# Altium schematic sheet SysUprTestUUUp.SchDoc (part 1 of 2)
size 839 x 594 mm; DecimalNumber: Э- 917.01Э3; MainDevice: Плата управления; Name: Плата управления; PageSetup: Record=PageOptions|CenterHorizontal=True|CenterVertical=True|PrintScale=0.94|XCorrection=1.00|YCorrection=1.00|PrintKind=1|BorderSize=5000000|LeftOffset=0|BottomOffset=0|Orientation=1|PaperLength=1000|PaperWidth=1000|Scale=100|PaperSource=7|PrintQuality=-4|MediaType=1|DitherType=10|PaperKind=A4|PrintScaleMode=1; ApprovedBy: Кайбалдиев; CheckedBy: Савельев; DrawnBy: Соловьев; Engineer: Т.контр.; DocumentNumber: Э-917.01Э3; SheetNumber: 4; SheetTotal: 4; Title1str: Плата; Title2str: управления; DocumentType1str: Схема электрическая; DocumentType2str: принципиальная; ImagePath: Э-917.01
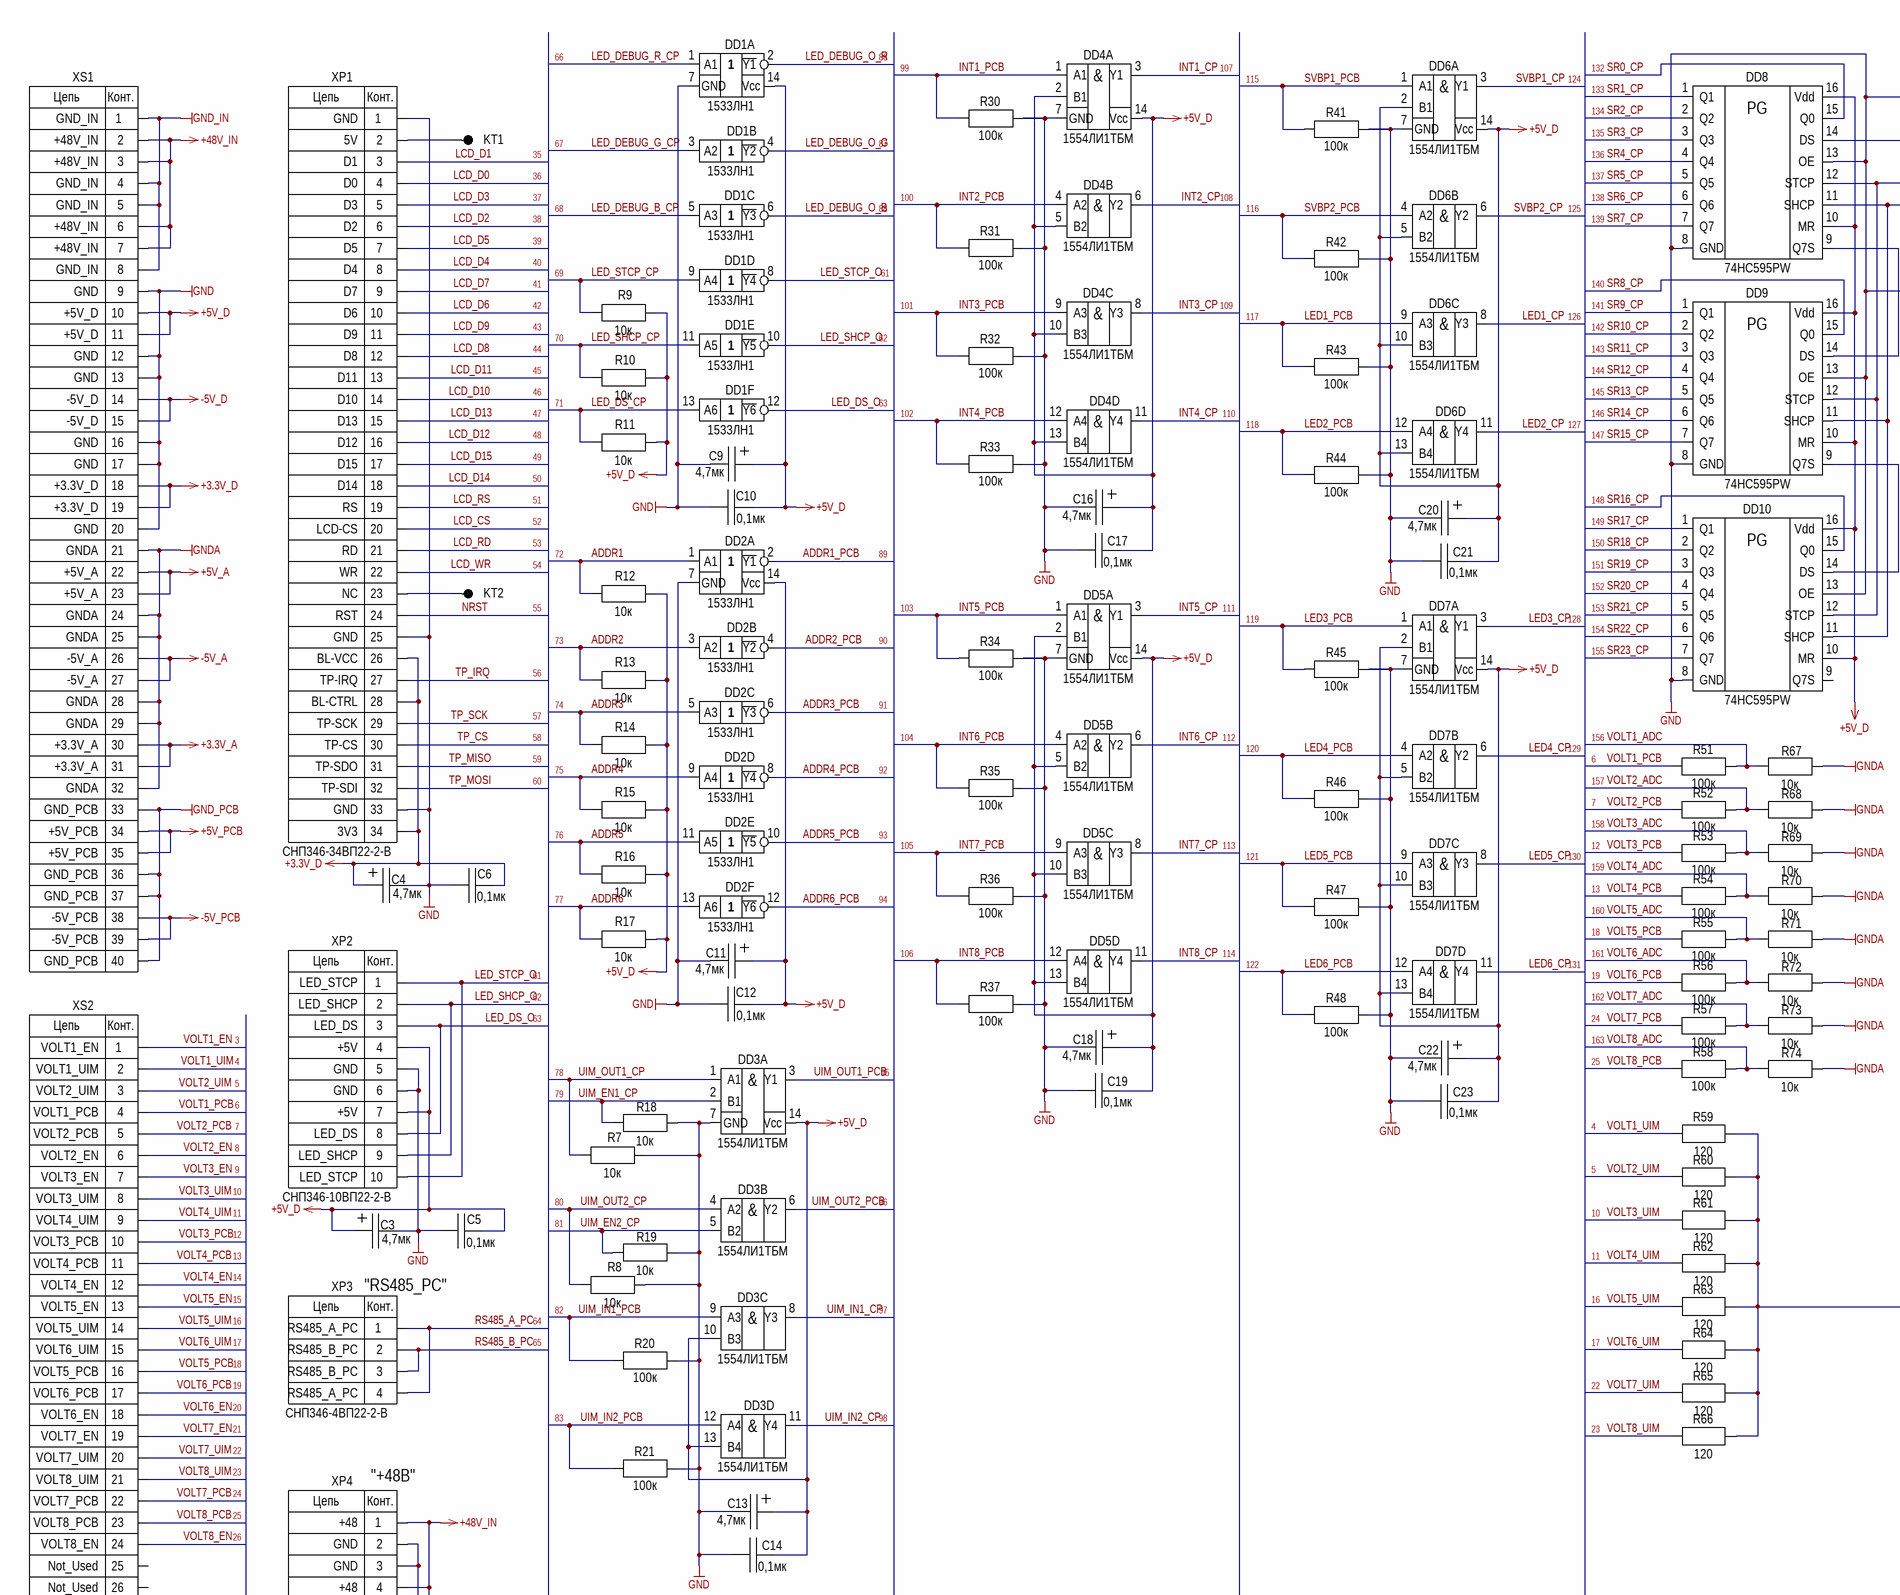
[diagram p0: SysUprTestUUUp.SchDoc, top left]
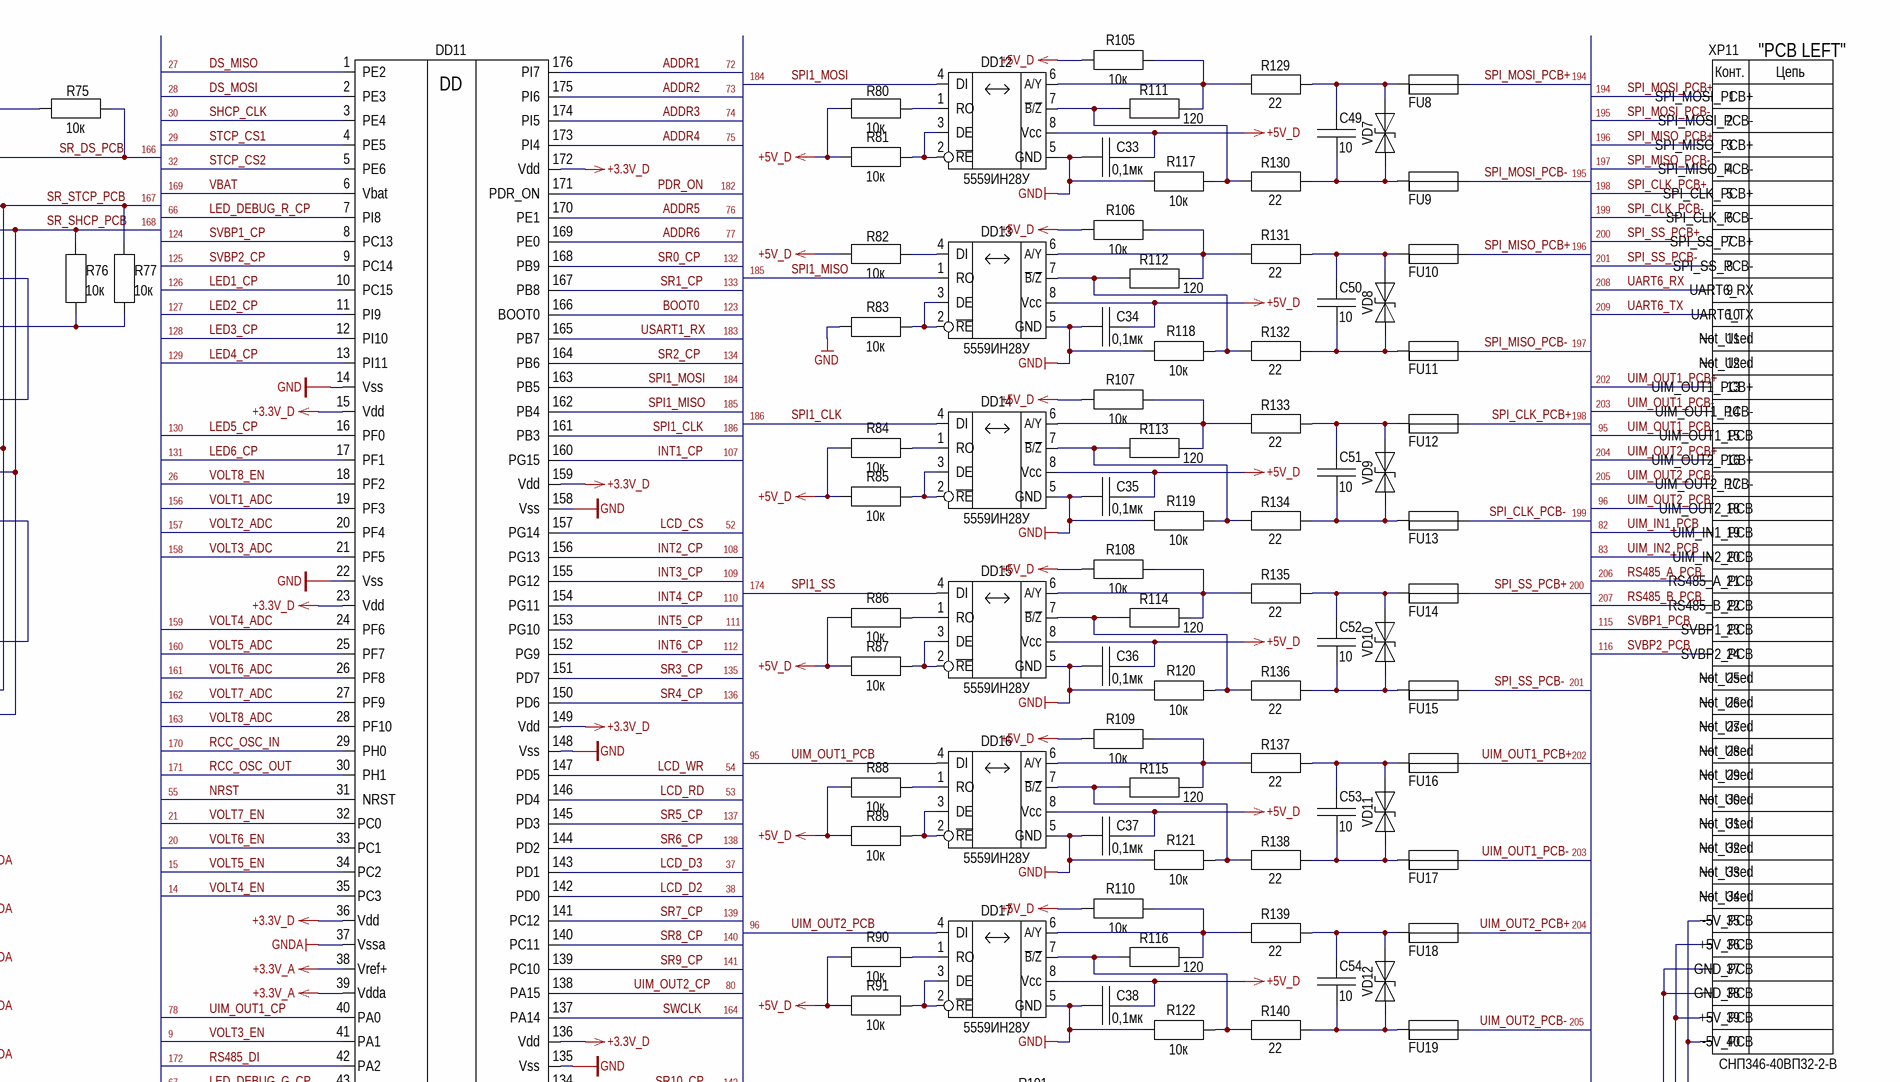
[diagram p1: SysUprTestUUUp.SchDoc, top right]
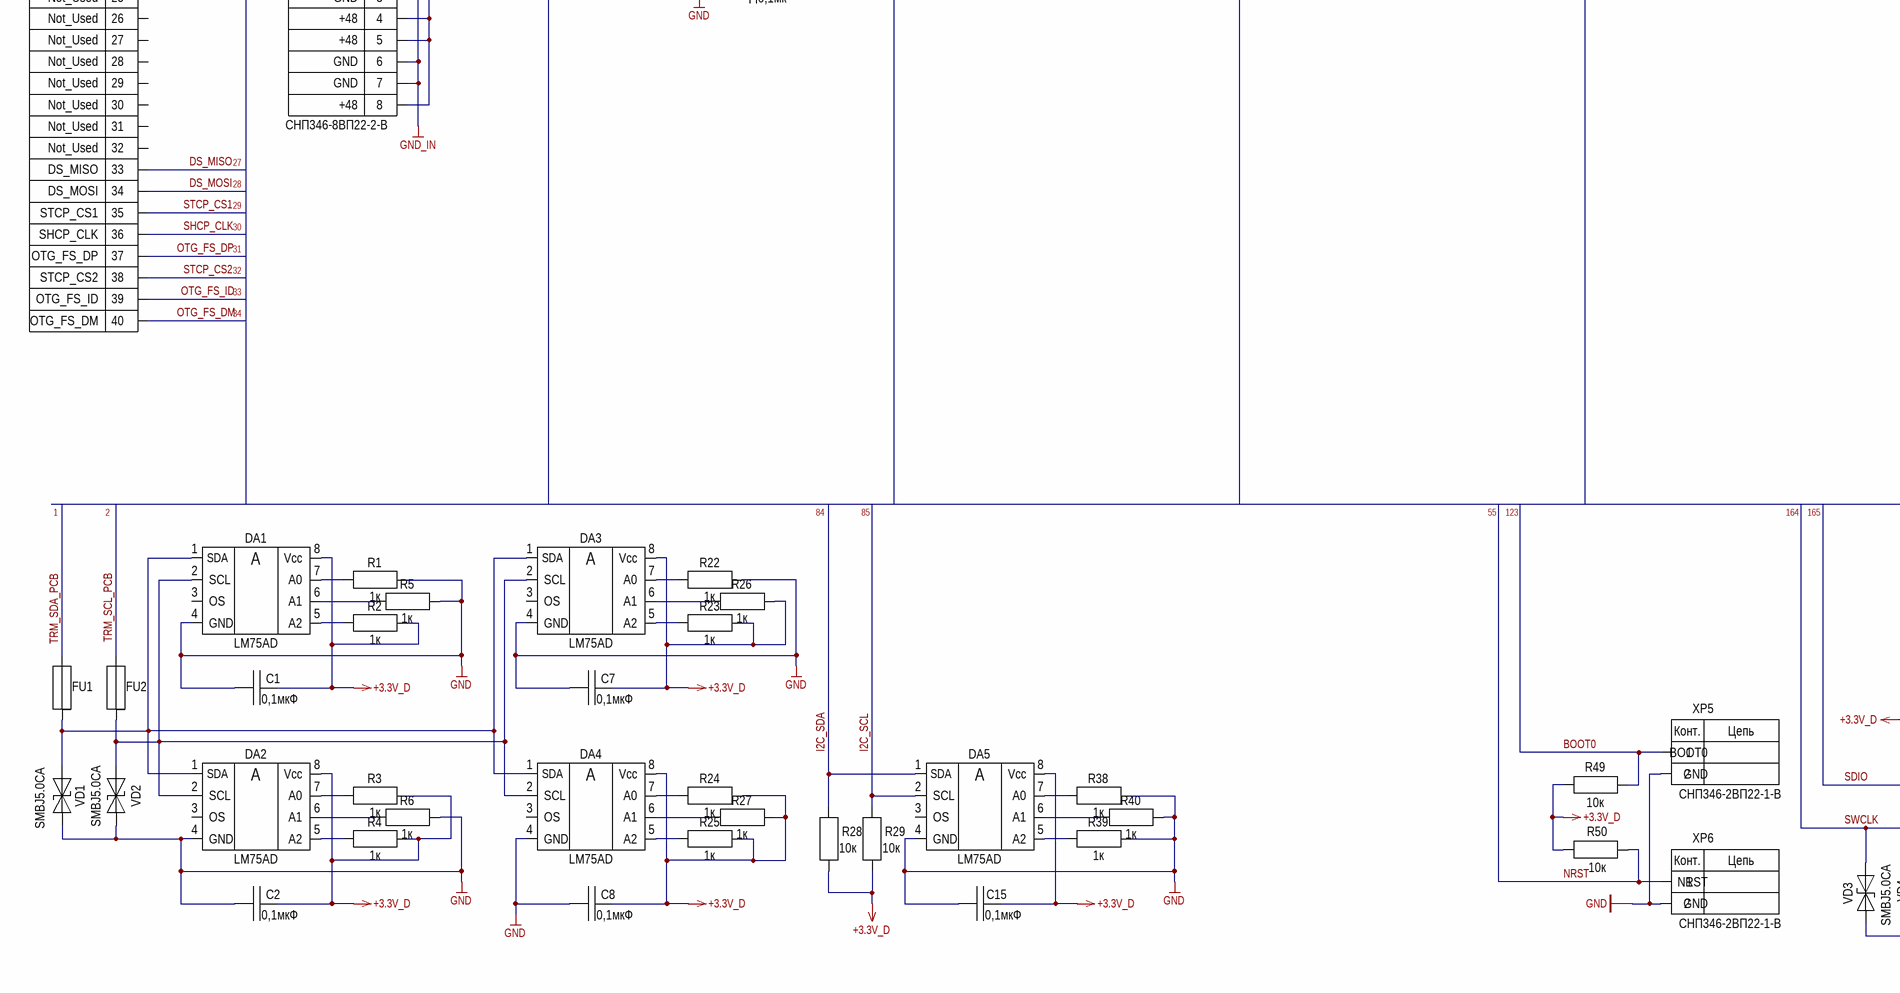
[diagram p2: SysUprTestUUUp.SchDoc, bottom left]
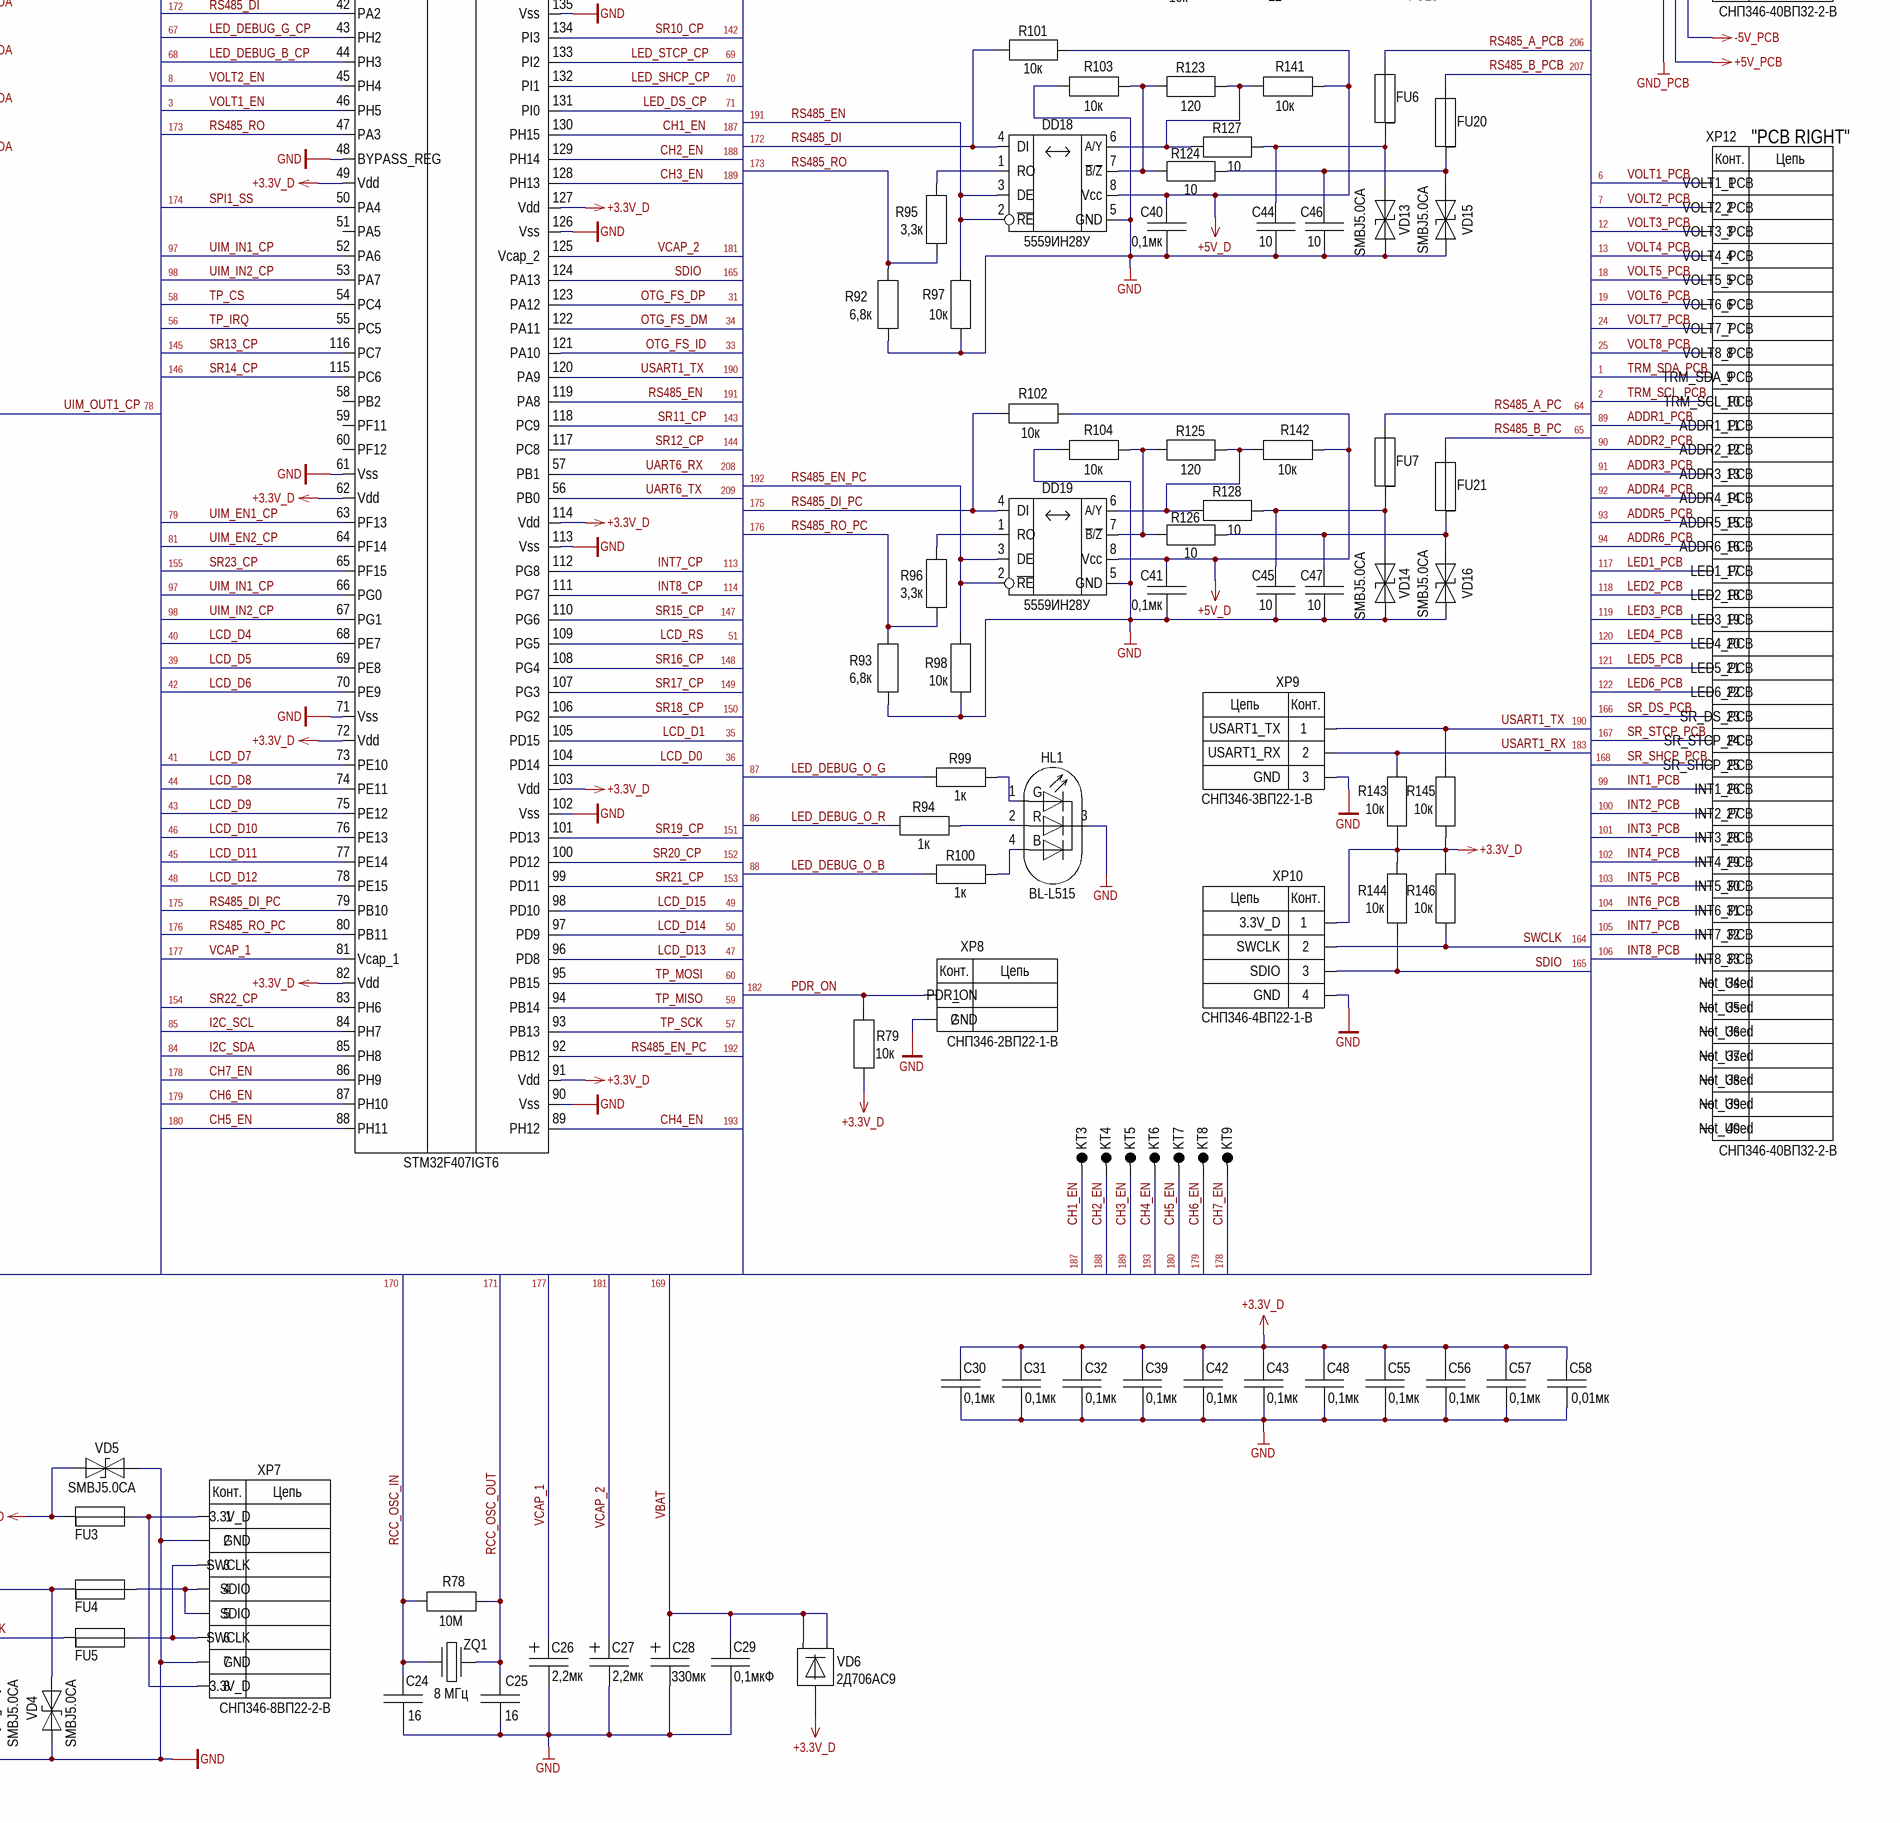
[diagram p3: SysUprTestUUUp.SchDoc, bottom right]

## Parts
C1  value 0,1мкФ  [Cap0805]  (hidden comment: Capacitor)
C2  value 0,1мкФ  [Cap0805]  (hidden comment: Capacitor)
C3  value 4,7мк  [CapCaseB]  (hidden comment: PolCap)
C4  value 4,7мк  [CapCaseB]  (hidden comment: PolCap)
C5  value 0,1мк  [Cap0805]  (hidden comment: Capacitor)
C6  value 0,1мк  [Cap0805]  (hidden comment: Capacitor)
C7  value 0,1мкФ  [Cap0805]  (hidden comment: Capacitor)
C8  value 0,1мкФ  [Cap0805]  (hidden comment: Capacitor)
C9  value 4,7мк  [CapCaseB]  (hidden comment: PolCap)
C10  value 0,1мк  [Cap0805]  (hidden comment: Capacitor)
C11  value 4,7мк  [CapCaseB]  (hidden comment: PolCap)
C12  value 0,1мк  [Cap0805]  (hidden comment: Capacitor)
C13  value 4,7мк  [CapCaseB]  (hidden comment: PolCap)
C14  value 0,1мк  [Cap0805]  (hidden comment: Capacitor)
C15  value 0,1мкФ  [Cap0805]  (hidden comment: Capacitor)
C16  value 4,7мк  [CapCaseB]  (hidden comment: PolCap)
C17  value 0,1мк  [Cap0805]  (hidden comment: Capacitor)
C18  value 4,7мк  [CapCaseB]  (hidden comment: PolCap)
C19  value 0,1мк  [Cap0805]  (hidden comment: Capacitor)
C20  value 4,7мк  [CapCaseB]  (hidden comment: PolCap)
C21  value 0,1мк  [Cap0805]  (hidden comment: Capacitor)
C22  value 4,7мк  [CapCaseB]  (hidden comment: PolCap)
C23  value 0,1мк  [Cap0805]  (hidden comment: Capacitor)
C24  value 16  [Cap0805]  (hidden comment: Capacitor)
C25  value 16  [Cap0805]  (hidden comment: Capacitor)
C26  value 2,2мк  [CapCaseB]  (hidden comment: PolCap)
C27  value 2,2мк  [CapCaseB]  (hidden comment: PolCap)
C28  value 330мк  [CapCaseD]  (hidden comment: PolCap)
C29  value 0,1мкФ  [Cap0805]  (hidden comment: Capacitor)
C30  value 0,1мк  [Cap0805]  (hidden comment: Capacitor)
C31  value 0,1мк  [Cap0805]  (hidden comment: Capacitor)
C32  value 0,1мк  [Cap0805]  (hidden comment: Capacitor)
C33  value 0,1мк  [Cap0805]  (hidden comment: Capacitor)
C34  value 0,1мк  [Cap0805]  (hidden comment: Capacitor)
C35  value 0,1мк  [Cap0805]  (hidden comment: Capacitor)
C36  value 0,1мк  [Cap0805]  (hidden comment: Capacitor)
C37  value 0,1мк  [Cap0805]  (hidden comment: Capacitor)
C38  value 0,1мк  [Cap0805]  (hidden comment: Capacitor)
C39  value 0,1мк  [Cap0805]  (hidden comment: Capacitor)
C40  value 0,1мк  [Cap0805]  (hidden comment: Capacitor)
C41  value 0,1мк  [Cap0805]  (hidden comment: Capacitor)
C42  value 0,1мк  [Cap0805]  (hidden comment: Capacitor)
C43  value 0,1мк  [Cap0805]  (hidden comment: Capacitor)
C44  value 10  [Cap0603]  (hidden comment: Capacitor)
C45  value 10  [Cap0603]  (hidden comment: Capacitor)
C46  value 10  [Cap0603]  (hidden comment: Capacitor)
C47  value 10  [Cap0603]  (hidden comment: Capacitor)
C48  value 0,1мк  [Cap0805]  (hidden comment: Capacitor)
C49  value 10  [Cap0603]  (hidden comment: Capacitor)
C50  value 10  [Cap0603]  (hidden comment: Capacitor)
C51  value 10  [Cap0603]  (hidden comment: Capacitor)
C52  value 10  [Cap0603]  (hidden comment: Capacitor)
C53  value 10  [Cap0603]  (hidden comment: Capacitor)
C54  value 10  [Cap0603]  (hidden comment: Capacitor)
C55  value 0,1мк  [Cap0805]  (hidden comment: Capacitor)
C56  value 0,1мк  [Cap0805]  (hidden comment: Capacitor)
C57  value 0,1мк  [Cap0805]  (hidden comment: Capacitor)
C58  value 0,01мк  [Cap0805]  (hidden comment: Capacitor)
DA1  LM75AD  [SO8]  (value not drawn)
DA2  LM75AD  [SO8]  (value not drawn)
DA3  LM75AD  [SO8]  (value not drawn)
DA4  LM75AD  [SO8]  (value not drawn)
DA5  LM75AD  [SO8]  (value not drawn)
DD1  1533LN1  [401.14-5]  (value not drawn)  (parts A,B,C,D,E,F of 6)
DD2  1533LN1  [401.14-5]  (value not drawn)  (parts A,B,C,D,E,F of 6)
DD3  1554LI1  [401.14-5_SO14]  (value not drawn)  (parts A,B,C,D of 4)
DD4  1554LI1  [401.14-5_SO14]  (value not drawn)  (parts A,B,C,D of 4)
DD5  1554LI1  [401.14-5_SO14]  (value not drawn)  (parts A,B,C,D of 4)
DD6  1554LI1  [401.14-5_SO14]  (value not drawn)  (parts A,B,C,D of 4)
DD7  1554LI1  [401.14-5_SO14]  (value not drawn)  (parts A,B,C,D of 4)
DD8  74HC595  [TSSOP16]  (value not drawn)
DD9  74HC595  [TSSOP16]  (value not drawn)
DD10  74HC595  [TSSOP16]  (value not drawn)
DD11  STM32F407IGT6  [LQFP176]
DD12  5559IN10U  [H02.8-1B_SOIC8]  (value not drawn)
DD13  5559IN10U  [H02.8-1B_SOIC8]  (value not drawn)
DD14  5559IN10U  [H02.8-1B_SOIC8]  (value not drawn)
DD15  5559IN10U  [H02.8-1B_SOIC8]  (value not drawn)
DD16  5559IN10U  [H02.8-1B_SOIC8]  (value not drawn)
DD17  5559IN10U  [H02.8-1B_SOIC8]  (value not drawn)
DD18  5559IN10U  [H02.8-1B_SOIC8]  (value not drawn)
DD19  5559IN10U  [H02.8-1B_SOIC8]  (value not drawn)
FU1  Predoxranitel  [MF-MSMF_1]  (value not drawn)
FU2  Predoxranitel  [MF-MSMF_1]  (value not drawn)
FU3  Predoxranitel  [MF-MSMF_1]  (value not drawn)
FU4  Predoxranitel  [MF-MSMF_1]  (value not drawn)
FU5  Predoxranitel  [MF-MSMF_1]  (value not drawn)
FU6  Predoxranitel  [MF-MSMF_1]  (value not drawn)
FU7  Predoxranitel  [MF-MSMF_1]  (value not drawn)
FU8  Predoxranitel  [MF-MSMF_1]  (value not drawn)
FU9  Predoxranitel  [MF-MSMF_1]  (value not drawn)
FU10  Predoxranitel  [MF-MSMF_1]  (value not drawn)
FU11  Predoxranitel  [MF-MSMF_1]  (value not drawn)
FU12  Predoxranitel  [MF-MSMF_1]  (value not drawn)